# EasyEDA Pro project Q's HelloWorld KeyBoard.eprj, schematic SCH 旋钮磁编码板V1.2
Create Date: 2022-10-16; Page Name: P1; Project Name: Q's HelloWorld KeyBoard; Schematic Name: SCH 旋钮磁编码板V1.2; Update Date: 2022-10-16; Company: 嘉立创EDA; Page Size: A4; Version: V1.0
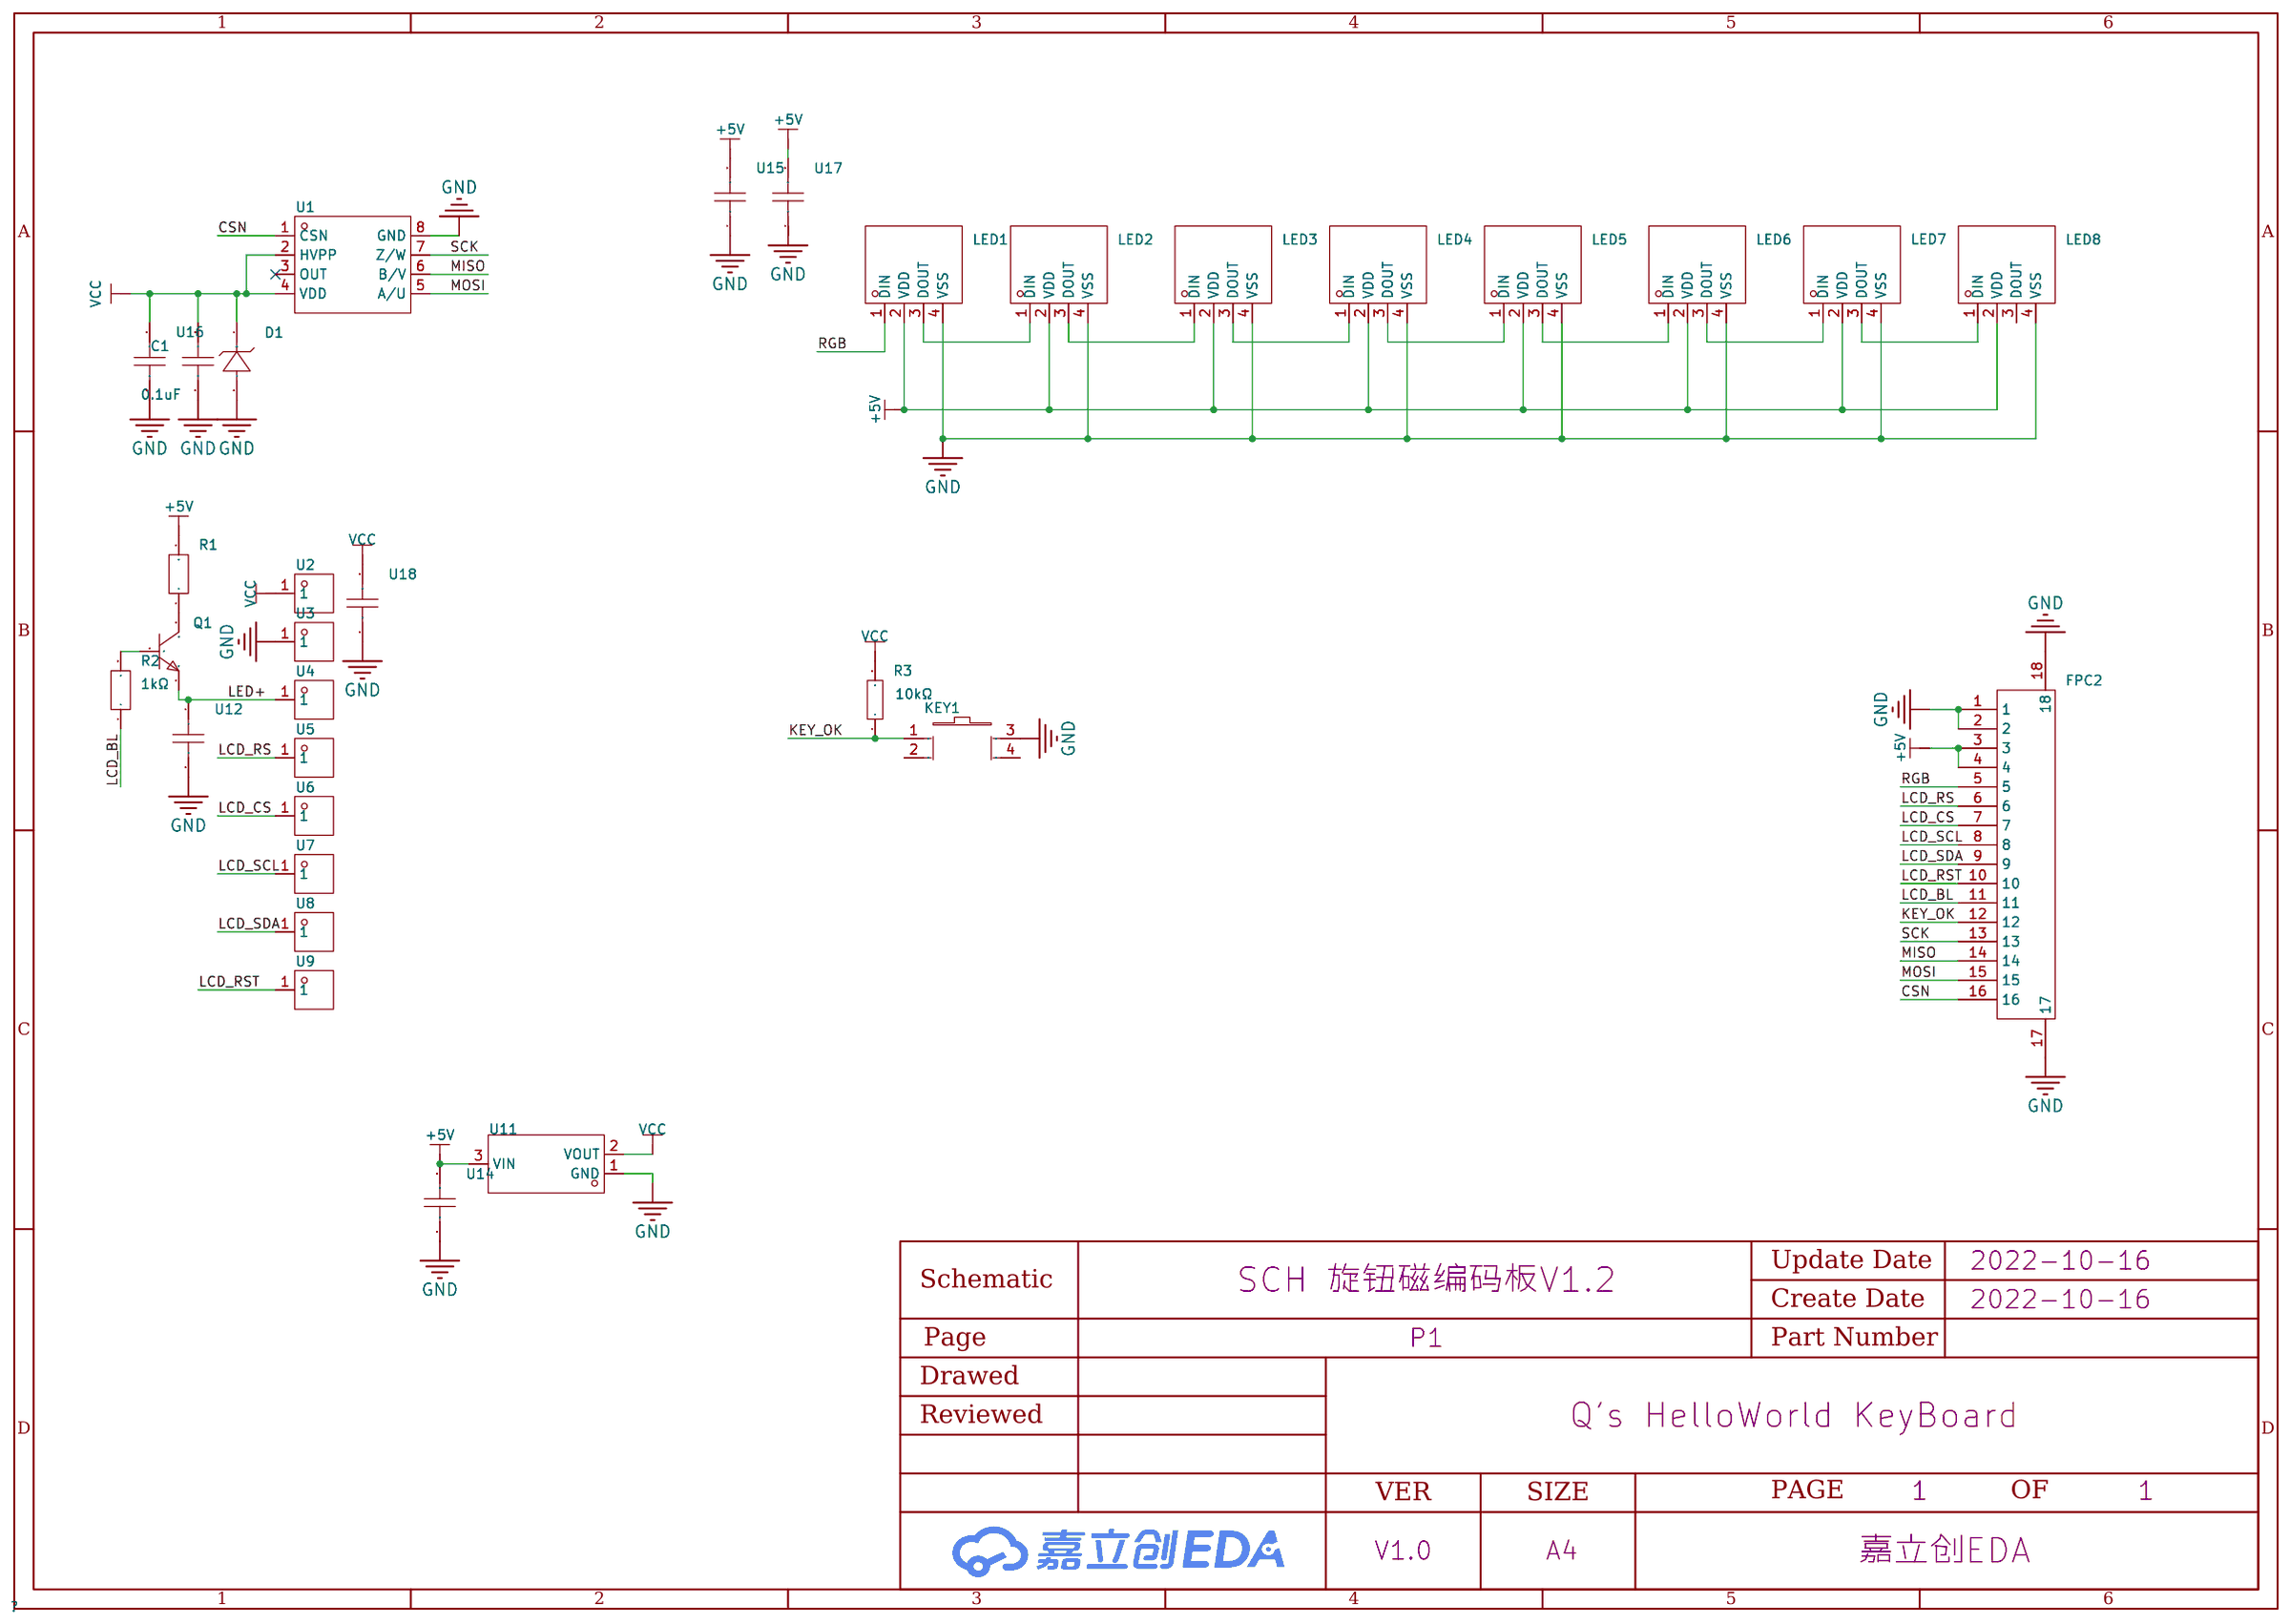
[diagram p6: schematic sheet]

## Parts
C1  0.1uF  [C0402]
D1  SMFJ6.0A  [SOD-123_L2.8-W1.8-LS3.7-RD]
FPC2  AFC01-S16FCA-00  [FPC-SMD_P0.50-16P_FGS-XJ-H2.0]
KEY1  KFC-A06-21ATH编带  [KEY-SMD_4P-L6.0-W6.0-P4.50]
LED1  WS2812B-4020  [LED-SMD_WS2812B-4020]
LED2  WS2812B-4020  [LED-SMD_WS2812B-4020]
LED3  WS2812B-4020  [LED-SMD_WS2812B-4020]
LED4  WS2812B-4020  [LED-SMD_WS2812B-4020]
LED5  WS2812B-4020  [LED-SMD_WS2812B-4020]
LED6  WS2812B-4020  [LED-SMD_WS2812B-4020]
LED7  WS2812B-4020  [LED-SMD_WS2812B-4020]
LED8  WS2812B-4020  [LED-SMD_WS2812B-4020]
Q1  S8050  [SOT-23-3_L2.9-W1.6-P1.90-LS2.8-BR]
R1  0402 ±5% 10Ω  [R0402]
R2  1kΩ  [R0402]
R3  10kΩ  [R0402]
U1  MT6816CT-ACD  [SOP-8_L5.0-W4.0-P1.27-LS6.0-BL]
U2  TP-黄色测试点  [TESTPOINT-TH_BD3.2]
U3  TP-黄色测试点  [TESTPOINT-TH_BD3.2]
U4  TP-黄色测试点  [TESTPOINT-TH_BD3.2]
U5  TP-黄色测试点  [TESTPOINT-TH_BD3.2]
U6  TP-黄色测试点  [TESTPOINT-TH_BD3.2]
U7  TP-黄色测试点  [TESTPOINT-TH_BD3.2]
U8  TP-黄色测试点  [TESTPOINT-TH_BD3.2]
U9  TP-黄色测试点  [TESTPOINT-TH_BD3.2]
U11  XC6206P332MR(1uA)  [SOT-23-3_L2.9-W1.6-P1.90-LS2.8-BR]
U12  1uF-c0402  [C0402]
U14  10uF/50V-0603  [C0603]
U15  10uF/50V-0603  [C0603]
U16  10uF/50V-0603  [C0603]
U17  10uF/50V-0603  [C0603]
U18  10uF/50V-0603  [C0603]

## Library data of the parts
C1 = 0402BB104K160NGT: 容值:0.1uF;精度:±10%;额定电压:16V;温度系数:-;; LCSC Part Name: 0.1uF ±10% 16V; Supplier Part: C2173076; Manufacturer: Knowles(楼氏); Supplier Footprint: 0402; JLCPCB Part Class: Extended Part; Datasheet: https://atta.szlcsc.com/upload/public/pdf/source/20210426/55B82DB4A9EC19DEFEE13887341FCC08.pdf; Supplier: LCSC; Tolerance: ±10%; Voltage Rated: 16V
D1 = SMFJ6.0A: 极性:单向;反向截止电压(Vrwm):6V;击穿电压(最小值):6.67V;峰值脉冲电流(Ipp)@10/1000s:19.4A;最大钳位电压:10.3V;; LCSC Part Name: 单向 6V; Supplier Part: C501388; Manufacturer: Me-TECH(美台高科); Supplier Footprint: SOD-123; JLCPCB Part Class: Extended Part; Datasheet: https://atta.szlcsc.com/upload/public/pdf/source/20200325/C501388_BDF4B38EFEB733A54D0F6372AED15AD3.pdf; Supplier: LCSC; Polarity: 单向; Reverse Stand-Off Voltage (Vrwm): 6V; Breakdown Voltage (Min): 6.67V; Peak Pulse Current (Ipp)@10/1000μs: 19.4A; Maximum Clamping Voltage: 10.3V
FPC2 = AFC01-S16FCA-00: 间距:0.5mm;触点数量:16;锁定特性:翻盖式;安装类型:卧贴;触点类型:下接;; LCSC Part Name: 0.5mm P数:16 翻盖式 下接; Supplier Part: C262665; Manufacturer: JS(钜硕电子); Supplier Footprint: SMD,P=0.5mm; JLCPCB Part Class: Extended Part; Datasheet: https://atta.szlcsc.com/upload/public/pdf/source/20180814/C262665_DC336C287B4B4904E7F77F7A745F9142.pdf; Supplier: LCSC; Pitch: 0.5mm; Number of Contacts: 16; Locking Feature: 翻盖式; Mounting Type: 卧贴; Contact Type: 下接; Height Above Board: 2mm; FFC, FCB Thickness: 0.3mm
KEY1 = KFC-A06-21ATH编带: 耐温260度; LCSC Part Name: KFC-A06-21ATH   260G; Supplier Part: C43230; Supplier Footprint: 6*6*5; JLCPCB Part Class: Extended Part; Datasheet: https://atta.szlcsc.com/upload/public/pdf/source/20151024/1457707488465.pdf; Supplier: LCSC
LED1-LED8 = WS2812B-4020: 发光颜色:RGB三色;二极管配置:-;透镜颜色:-;主波长:465nm~475nm；620nm~625nm；515nm~525nm;峰值波长:-;色温:-;光通量(25时):-;测试电流:12mA;正向电压(VF):-;发光强度:1000mcd；300mcd；500mcd;功率:-;发光角度:-;安装方式:-;工作温度:-;; LCSC Part Name: RGB三色 （注意防潮，请查阅规格书中对应具体内容）; Supplier Part: C965557; Manufacturer: worldsemi; Supplier Footprint: SMD,2x4mm; JLCPCB Part Class: Extended Part; Datasheet: https://atta.szlcsc.com/upload/public/pdf/source/20201203/C965557_D4D919E14814D6BA44043987D39B5520.pdf; Supplier: LCSC; Emitted Color: RGB三色; Dominant Wavelength: 465nm~475nm；620nm~625nm；515nm~525nm; Forward Current: 12mA; Luminous Intensity: 1000mcd；300mcd；500mcd
Q1 = S8050: 晶体管类型:NPN;集射极击穿电压(Vceo):25V;集电极电流(Ic):500mA;功率(Pd):300mW;集电极-发射极饱和电压(VCE(sat)@Ic,Ib):600mV@500mA,50mA;直流电流增益(hFE@Ic,Vce):120@50mA,1V;特征频率(fT):150MHz;工作温度:+150@(Tj);; LCSC Part Name: S8050 L档120-200 L档120-200; Supplier Part: C105433; Manufacturer: CJ（江苏长电/长晶）; Supplier Footprint: SOT-23(SOT-23-3); JLCPCB Part Class: Extended Part; Datasheet: https://atta.szlcsc.com/upload/public/pdf/source/20170415/1492237762328.pdf; Supplier: LCSC; Transistor Type: NPN; Collector-Emitter Breakdown Voltage (Vceo): 25V; Collector Current (Ic): 500mA; Power Dissipation (Pd): 300mW; Collector-Emitter Saturation Voltage (VCE(sat)@Ic,Ib): 600mV@500mA,50mA; DC Current Gain (hFE@Ic,Vce): 120@50mA,1V; Transition Frequency (fT): 150MHz; Operating Temperature: +150@(Tj)
R1 = 0402 ±5% 10Ω: 功率:1/16W; LCSC Part Name: 10Ω ±5%; Supplier Part: C2889362; Manufacturer: VO(翔胜); Supplier Footprint: 0402; JLCPCB Part Class: Extended Part; Datasheet: https://atta.szlcsc.com/upload/public/pdf/source/20210902/777BF6DFB3B29B13210374B07BC23D84.pdf; Supplier: LCSC
R2 = RGC0402DTC1K00: 电阻类型:厚膜电阻;阻值:1kΩ;精度:±0.5%;功率:63mW;温度系数:±50ppm/;最大工作电压:50V;工作温度范围:-55~+155;; LCSC Part Name: 1kΩ ±0.5%; Supplier Part: C346870; Manufacturer: SEI(Stackpole Electronics Inc.); Supplier Footprint: 0402; JLCPCB Part Class: Extended Part; Datasheet: https://atta.szlcsc.com/upload/public/pdf/source/20190409/C346870_DF8535DF3F82A12D6BC2A2F195C56E67.pdf; Supplier: LCSC; Type: 厚膜电阻; Tolerance: ±0.5%; Power(Watts): 63mW; Temperature Coefficient: ±50ppm/; Overload Voltage (Max): 50V; Operating Temperature Range: -55~+155
R3 = AECR0402F10K0K9: 功率:0.063W;阻值:10kΩ;精度:±1%;; LCSC Part Name: 10KΩ(1002) ±1%; Supplier Part: C328298; Manufacturer: RESI(开步睿思）; Supplier Footprint: 0402; JLCPCB Part Class: Extended Part; Datasheet: https://atta.szlcsc.com/upload/public/pdf/source/20181108/C328298_2E8721712DFDC25EDA989FDD55A2877F.pdf; Supplier: LCSC; Power(Watts): 0.063W; Tolerance: ±1%
U1 = MT6816CT-ACD: AB=1024线，Z=4LSB，PWM=1KHz; LCSC Part Name: 零延迟磁角位置传感器IC; Supplier Part: C879560; Manufacturer: MagnTek(麦歌恩); Supplier Footprint: SOP-8; JLCPCB Part Class: Extended Part; Datasheet: https://atta.szlcsc.com/upload/public/pdf/source/20201027/C879560_21F27A21E71569DDEA564795613A647F.pdf; Supplier: LCSC
U2-U9 = TP-黄色测试点: Supplier Part: C9900007422; Supplier Footprint: TESTPOINT-TH_BD-2P-P2.00; JLCPCB Part Class: Extended Part; Datasheet: https://atta.szlcsc.comnull; Supplier: LCSC
U11 = XC6206P332MR(1uA): 输出类型:-;; Supplier Part: C2827648; Manufacturer: TECH PUBLIC(台舟); Supplier Footprint: SOT-23-3L; JLCPCB Part Class: Extended Part; Datasheet: https://atta.szlcsc.com/upload/public/pdf/source/20210810/97CC0812A7725EE2472CEA147F9F2323.pdf; Supplier: LCSC
U12 = 1uF-c0402: Supplier Part: C9900009000; JLCPCB Part Class: Extended Part; Datasheet: https://atta.szlcsc.comnull; Supplier: LCSC
U14-U18 = 10uF/50V-0603: Supplier Part: C9900002080; JLCPCB Part Class: Extended Part; Datasheet: https://atta.szlcsc.comnull; Supplier: LCSC

## Nets
+5V: FPC2.3 FPC2.4 LED1.2(VDD) LED2.2(VDD) LED3.2(VDD) LED4.2(VDD) LED5.2(VDD) LED6.2(VDD) LED7.2(VDD) LED8.2(VDD) R1.2 U11.3(VIN) U14.2 U15.2 U17.2
GND: C1.1 D1.2(A) FPC2.1 FPC2.2 FPC2.17 FPC2.18 KEY1.3 LED1.4(VSS) LED2.4(VSS) LED3.4(VSS) LED4.4(VSS) LED5.4(VSS) LED6.4(VSS) LED7.4(VSS) LED8.4(VSS) U1.8(GND) U3.1 U11.1(GND) U12.2 U14.1 U15.1 U16.1 U17.1 U18.1
VCC: C1.2 D1.1(C) R3.2 U1.2(HVPP) U1.4(VDD) U2.1 U11.2(VOUT) U16.2 U18.2
CSN: FPC2.16 U1.1(CSN)
KEY_OK: FPC2.12 KEY1.1 R3.1
LCD_BL: FPC2.11 R2.1
LCD_CS: FPC2.7 U6.1
LCD_RS: FPC2.6 U5.1
LCD_RST: FPC2.10 U9.1
LCD_SCL: FPC2.8 U7.1
LCD_SDA: FPC2.9 U8.1
LED+: Q1.2 U4.1 U12.1
MISO: FPC2.14 U1.6(B/V)
MOSI: FPC2.15 U1.5(A/U)
RGB: FPC2.5 LED1.1(DIN)
SCK: FPC2.13 U1.7(Z/W)
$1N2990: Q1.3 R1.1
$1N3139: Q1.1 R2.2
$1N12508: LED1.3(DOUT) LED2.1(DIN)
$1N12561: LED2.3(DOUT) LED3.1(DIN)
$1N12614: LED3.3(DOUT) LED4.1(DIN)
$1N12667: LED4.3(DOUT) LED5.1(DIN)
$1N12720: LED5.3(DOUT) LED6.1(DIN)
$1N12773: LED6.3(DOUT) LED7.1(DIN)
$1N12826: LED7.3(DOUT) LED8.1(DIN)

Not connected (* = marked no-connect by the designer): KEY1 2 4; LED8 3(DOUT); U1 3(OUT)*
